# Altium schematic sheet phototransistors.SchDoc: Phototransostors (part 2 of 3) (continued)
## Parts (continued)
T345  B19H1PT--H9C000214U1930  [LED0603W]  (value not drawn)
T346  B19H1PT--H9C000214U1930  [LED0603W]  (value not drawn)
T347  B19H1PT--H9C000214U1930  [LED0603W]  (value not drawn)
T348  B19H1PT--H9C000214U1930  [LED0603W]  (value not drawn)
T349  B19H1PT--H9C000214U1930  [LED0603W]  (value not drawn)
T350  B19H1PT--H9C000214U1930  [LED0603W]  (value not drawn)
T351  B19H1PT--H9C000214U1930  [LED0603W]  (value not drawn)
T352  B19H1PT--H9C000214U1930  [LED0603W]  (value not drawn)
T353  B19H1PT--H9C000214U1930  [LED0603W]  (value not drawn)
T354  B19H1PT--H9C000214U1930  [LED0603W]  (value not drawn)
T355  B19H1PT--H9C000214U1930  [LED0603W]  (value not drawn)
T356  B19H1PT--H9C000214U1930  [LED0603W]  (value not drawn)
T357  B19H1PT--H9C000214U1930  [LED0603W]  (value not drawn)
T358  B19H1PT--H9C000214U1930  [LED0603W]  (value not drawn)
T359  B19H1PT--H9C000214U1930  [LED0603W]  (value not drawn)
T360  B19H1PT--H9C000214U1930  [LED0603W]  (value not drawn)
T361  B19H1PT--H9C000214U1930  [LED0603W]  (value not drawn)
T362  B19H1PT--H9C000214U1930  [LED0603W]  (value not drawn)
T363  B19H1PT--H9C000214U1930  [LED0603W]  (value not drawn)
T364  B19H1PT--H9C000214U1930  [LED0603W]  (value not drawn)
T365  B19H1PT--H9C000214U1930  [LED0603W]  (value not drawn)
T366  B19H1PT--H9C000214U1930  [LED0603W]  (value not drawn)
T367  B19H1PT--H9C000214U1930  [LED0603W]  (value not drawn)
T368  B19H1PT--H9C000214U1930  [LED0603W]  (value not drawn)
T369  B19H1PT--H9C000214U1930  [LED0603W]  (value not drawn)
T370  B19H1PT--H9C000214U1930  [LED0603W]  (value not drawn)
T371  B19H1PT--H9C000214U1930  [LED0603W]  (value not drawn)
T372  B19H1PT--H9C000214U1930  [LED0603W]  (value not drawn)
T373  B19H1PT--H9C000214U1930  [LED0603W]  (value not drawn)
T374  B19H1PT--H9C000214U1930  [LED0603W]  (value not drawn)
T375  B19H1PT--H9C000214U1930  [LED0603W]  (value not drawn)
T376  B19H1PT--H9C000214U1930  [LED0603W]  (value not drawn)
T377  B19H1PT--H9C000214U1930  [LED0603W]  (value not drawn)
T378  B19H1PT--H9C000214U1930  [LED0603W]  (value not drawn)
T379  B19H1PT--H9C000214U1930  [LED0603W]  (value not drawn)
T380  B19H1PT--H9C000214U1930  [LED0603W]  (value not drawn)
T381  B19H1PT--H9C000214U1930  [LED0603W]  (value not drawn)
T382  B19H1PT--H9C000214U1930  [LED0603W]  (value not drawn)
T383  B19H1PT--H9C000214U1930  [LED0603W]  (value not drawn)
T384  B19H1PT--H9C000214U1930  [LED0603W]  (value not drawn)
T385  B19H1PT--H9C000214U1930  [LED0603W]  (value not drawn)
T386  B19H1PT--H9C000214U1930  [LED0603W]  (value not drawn)
T387  B19H1PT--H9C000214U1930  [LED0603W]  (value not drawn)
T388  B19H1PT--H9C000214U1930  [LED0603W]  (value not drawn)
T389  B19H1PT--H9C000214U1930  [LED0603W]  (value not drawn)
T390  B19H1PT--H9C000214U1930  [LED0603W]  (value not drawn)
T391  B19H1PT--H9C000214U1930  [LED0603W]  (value not drawn)
T392  B19H1PT--H9C000214U1930  [LED0603W]  (value not drawn)
T393  B19H1PT--H9C000214U1930  [LED0603W]  (value not drawn)
T394  B19H1PT--H9C000214U1930  [LED0603W]  (value not drawn)
T395  B19H1PT--H9C000214U1930  [LED0603W]  (value not drawn)
T396  B19H1PT--H9C000214U1930  [LED0603W]  (value not drawn)
T397  B19H1PT--H9C000214U1930  [LED0603W]  (value not drawn)
T398  B19H1PT--H9C000214U1930  [LED0603W]  (value not drawn)
T399  B19H1PT--H9C000214U1930  [LED0603W]  (value not drawn)
T400  B19H1PT--H9C000214U1930  [LED0603W]  (value not drawn)
T401  B19H1PT--H9C000214U1930  [LED0603W]  (value not drawn)
T402  B19H1PT--H9C000214U1930  [LED0603W]  (value not drawn)
T403  B19H1PT--H9C000214U1930  [LED0603W]  (value not drawn)
T404  B19H1PT--H9C000214U1930  [LED0603W]  (value not drawn)
T405  B19H1PT--H9C000214U1930  [LED0603W]  (value not drawn)
T406  B19H1PT--H9C000214U1930  [LED0603W]  (value not drawn)
T407  B19H1PT--H9C000214U1930  [LED0603W]  (value not drawn)
T408  B19H1PT--H9C000214U1930  [LED0603W]  (value not drawn)
T409  B19H1PT--H9C000214U1930  [LED0603W]  (value not drawn)
T410  B19H1PT--H9C000214U1930  [LED0603W]  (value not drawn)
T411  B19H1PT--H9C000214U1930  [LED0603W]  (value not drawn)
T412  B19H1PT--H9C000214U1930  [LED0603W]  (value not drawn)
T413  B19H1PT--H9C000214U1930  [LED0603W]  (value not drawn)
T414  B19H1PT--H9C000214U1930  [LED0603W]  (value not drawn)
T415  B19H1PT--H9C000214U1930  [LED0603W]  (value not drawn)
T416  B19H1PT--H9C000214U1930  [LED0603W]  (value not drawn)
T417  B19H1PT--H9C000214U1930  [LED0603W]  (value not drawn)
T418  B19H1PT--H9C000214U1930  [LED0603W]  (value not drawn)
T419  B19H1PT--H9C000214U1930  [LED0603W]  (value not drawn)
T420  B19H1PT--H9C000214U1930  [LED0603W]  (value not drawn)
T421  B19H1PT--H9C000214U1930  [LED0603W]  (value not drawn)
T422  B19H1PT--H9C000214U1930  [LED0603W]  (value not drawn)
T423  B19H1PT--H9C000214U1930  [LED0603W]  (value not drawn)
T424  B19H1PT--H9C000214U1930  [LED0603W]  (value not drawn)
T425  B19H1PT--H9C000214U1930  [LED0603W]  (value not drawn)
T426  B19H1PT--H9C000214U1930  [LED0603W]  (value not drawn)
T427  B19H1PT--H9C000214U1930  [LED0603W]  (value not drawn)
T428  B19H1PT--H9C000214U1930  [LED0603W]  (value not drawn)
T429  B19H1PT--H9C000214U1930  [LED0603W]  (value not drawn)
T430  B19H1PT--H9C000214U1930  [LED0603W]  (value not drawn)
T431  B19H1PT--H9C000214U1930  [LED0603W]  (value not drawn)
T432  B19H1PT--H9C000214U1930  [LED0603W]  (value not drawn)
T433  B19H1PT--H9C000214U1930  [LED0603W]  (value not drawn)
T434  B19H1PT--H9C000214U1930  [LED0603W]  (value not drawn)
T435  B19H1PT--H9C000214U1930  [LED0603W]  (value not drawn)
T436  B19H1PT--H9C000214U1930  [LED0603W]  (value not drawn)
T437  B19H1PT--H9C000214U1930  [LED0603W]  (value not drawn)
T438  B19H1PT--H9C000214U1930  [LED0603W]  (value not drawn)
T439  B19H1PT--H9C000214U1930  [LED0603W]  (value not drawn)
T440  B19H1PT--H9C000214U1930  [LED0603W]  (value not drawn)
T441  B19H1PT--H9C000214U1930  [LED0603W]  (value not drawn)
T442  B19H1PT--H9C000214U1930  [LED0603W]  (value not drawn)
T443  B19H1PT--H9C000214U1930  [LED0603W]  (value not drawn)
T444  B19H1PT--H9C000214U1930  [LED0603W]  (value not drawn)
T445  B19H1PT--H9C000214U1930  [LED0603W]  (value not drawn)
T446  B19H1PT--H9C000214U1930  [LED0603W]  (value not drawn)
T447  B19H1PT--H9C000214U1930  [LED0603W]  (value not drawn)
T448  B19H1PT--H9C000214U1930  [LED0603W]  (value not drawn)
T449  B19H1PT--H9C000214U1930  [LED0603W]  (value not drawn)
T450  B19H1PT--H9C000214U1930  [LED0603W]  (value not drawn)
T451  B19H1PT--H9C000214U1930  [LED0603W]  (value not drawn)
T452  B19H1PT--H9C000214U1930  [LED0603W]  (value not drawn)
T453  B19H1PT--H9C000214U1930  [LED0603W]  (value not drawn)
T454  B19H1PT--H9C000214U1930  [LED0603W]  (value not drawn)
T455  B19H1PT--H9C000214U1930  [LED0603W]  (value not drawn)
T456  B19H1PT--H9C000214U1930  [LED0603W]  (value not drawn)
T457  B19H1PT--H9C000214U1930  [LED0603W]  (value not drawn)
T458  B19H1PT--H9C000214U1930  [LED0603W]  (value not drawn)
T459  B19H1PT--H9C000214U1930  [LED0603W]  (value not drawn)
T460  B19H1PT--H9C000214U1930  [LED0603W]  (value not drawn)
T461  B19H1PT--H9C000214U1930  [LED0603W]  (value not drawn)
T462  B19H1PT--H9C000214U1930  [LED0603W]  (value not drawn)
T463  B19H1PT--H9C000214U1930  [LED0603W]  (value not drawn)
T464  B19H1PT--H9C000214U1930  [LED0603W]  (value not drawn)
T465  B19H1PT--H9C000214U1930  [LED0603W]  (value not drawn)
T466  B19H1PT--H9C000214U1930  [LED0603W]  (value not drawn)
T467  B19H1PT--H9C000214U1930  [LED0603W]  (value not drawn)
T468  B19H1PT--H9C000214U1930  [LED0603W]  (value not drawn)
T469  B19H1PT--H9C000214U1930  [LED0603W]  (value not drawn)
T470  B19H1PT--H9C000214U1930  [LED0603W]  (value not drawn)
T471  B19H1PT--H9C000214U1930  [LED0603W]  (value not drawn)
T472  B19H1PT--H9C000214U1930  [LED0603W]  (value not drawn)
T473  B19H1PT--H9C000214U1930  [LED0603W]  (value not drawn)
T474  B19H1PT--H9C000214U1930  [LED0603W]  (value not drawn)
T475  B19H1PT--H9C000214U1930  [LED0603W]  (value not drawn)
T476  B19H1PT--H9C000214U1930  [LED0603W]  (value not drawn)
T477  B19H1PT--H9C000214U1930  [LED0603W]  (value not drawn)
T478  B19H1PT--H9C000214U1930  [LED0603W]  (value not drawn)
T479  B19H1PT--H9C000214U1930  [LED0603W]  (value not drawn)
T480  B19H1PT--H9C000214U1930  [LED0603W]  (value not drawn)
T481  B19H1PT--H9C000214U1930  [LED0603W]  (value not drawn)
T482  B19H1PT--H9C000214U1930  [LED0603W]  (value not drawn)
T483  B19H1PT--H9C000214U1930  [LED0603W]  (value not drawn)
T484  B19H1PT--H9C000214U1930  [LED0603W]  (value not drawn)
T485  B19H1PT--H9C000214U1930  [LED0603W]  (value not drawn)
T486  B19H1PT--H9C000214U1930  [LED0603W]  (value not drawn)
T487  B19H1PT--H9C000214U1930  [LED0603W]  (value not drawn)
T488  B19H1PT--H9C000214U1930  [LED0603W]  (value not drawn)
T489  B19H1PT--H9C000214U1930  [LED0603W]  (value not drawn)
T490  B19H1PT--H9C000214U1930  [LED0603W]  (value not drawn)
T491  B19H1PT--H9C000214U1930  [LED0603W]  (value not drawn)
T492  B19H1PT--H9C000214U1930  [LED0603W]  (value not drawn)
T493  B19H1PT--H9C000214U1930  [LED0603W]  (value not drawn)
T494  B19H1PT--H9C000214U1930  [LED0603W]  (value not drawn)
T495  B19H1PT--H9C000214U1930  [LED0603W]  (value not drawn)
T496  B19H1PT--H9C000214U1930  [LED0603W]  (value not drawn)
T497  B19H1PT--H9C000214U1930  [LED0603W]  (value not drawn)
T498  B19H1PT--H9C000214U1930  [LED0603W]  (value not drawn)
T499  B19H1PT--H9C000214U1930  [LED0603W]  (value not drawn)
T500  B19H1PT--H9C000214U1930  [LED0603W]  (value not drawn)
T501  B19H1PT--H9C000214U1930  [LED0603W]  (value not drawn)
T502  B19H1PT--H9C000214U1930  [LED0603W]  (value not drawn)
T503  B19H1PT--H9C000214U1930  [LED0603W]  (value not drawn)
T504  B19H1PT--H9C000214U1930  [LED0603W]  (value not drawn)
T505  B19H1PT--H9C000214U1930  [LED0603W]  (value not drawn)
T506  B19H1PT--H9C000214U1930  [LED0603W]  (value not drawn)
T507  B19H1PT--H9C000214U1930  [LED0603W]  (value not drawn)
T508  B19H1PT--H9C000214U1930  [LED0603W]  (value not drawn)
T509  B19H1PT--H9C000214U1930  [LED0603W]  (value not drawn)
T510  B19H1PT--H9C000214U1930  [LED0603W]  (value not drawn)
T511  B19H1PT--H9C000214U1930  [LED0603W]  (value not drawn)
T512  B19H1PT--H9C000214U1930  [LED0603W]  (value not drawn)
T513  B19H1PT--H9C000214U1930  [LED0603W]  (value not drawn)
T514  B19H1PT--H9C000214U1930  [LED0603W]  (value not drawn)
T515  B19H1PT--H9C000214U1930  [LED0603W]  (value not drawn)
T516  B19H1PT--H9C000214U1930  [LED0603W]  (value not drawn)
T517  B19H1PT--H9C000214U1930  [LED0603W]  (value not drawn)
T518  B19H1PT--H9C000214U1930  [LED0603W]  (value not drawn)
T519  B19H1PT--H9C000214U1930  [LED0603W]  (value not drawn)
T520  B19H1PT--H9C000214U1930  [LED0603W]  (value not drawn)
T521  B19H1PT--H9C000214U1930  [LED0603W]  (value not drawn)
T522  B19H1PT--H9C000214U1930  [LED0603W]  (value not drawn)
T523  B19H1PT--H9C000214U1930  [LED0603W]  (value not drawn)
T524  B19H1PT--H9C000214U1930  [LED0603W]  (value not drawn)
T525  B19H1PT--H9C000214U1930  [LED0603W]  (value not drawn)
T526  B19H1PT--H9C000214U1930  [LED0603W]  (value not drawn)
T527  B19H1PT--H9C000214U1930  [LED0603W]  (value not drawn)
T528  B19H1PT--H9C000214U1930  [LED0603W]  (value not drawn)
T529  B19H1PT--H9C000214U1930  [LED0603W]  (value not drawn)
T530  B19H1PT--H9C000214U1930  [LED0603W]  (value not drawn)
T531  B19H1PT--H9C000214U1930  [LED0603W]  (value not drawn)
T532  B19H1PT--H9C000214U1930  [LED0603W]  (value not drawn)
T533  B19H1PT--H9C000214U1930  [LED0603W]  (value not drawn)
T534  B19H1PT--H9C000214U1930  [LED0603W]  (value not drawn)
T535  B19H1PT--H9C000214U1930  [LED0603W]  (value not drawn)
T536  B19H1PT--H9C000214U1930  [LED0603W]  (value not drawn)
T537  B19H1PT--H9C000214U1930  [LED0603W]  (value not drawn)
T538  B19H1PT--H9C000214U1930  [LED0603W]  (value not drawn)
T539  B19H1PT--H9C000214U1930  [LED0603W]  (value not drawn)
T540  B19H1PT--H9C000214U1930  [LED0603W]  (value not drawn)
T541  B19H1PT--H9C000214U1930  [LED0603W]  (value not drawn)
T542  B19H1PT--H9C000214U1930  [LED0603W]  (value not drawn)
T543  B19H1PT--H9C000214U1930  [LED0603W]  (value not drawn)
T544  B19H1PT--H9C000214U1930  [LED0603W]  (value not drawn)
T545  B19H1PT--H9C000214U1930  [LED0603W]  (value not drawn)
T546  B19H1PT--H9C000214U1930  [LED0603W]  (value not drawn)
T547  B19H1PT--H9C000214U1930  [LED0603W]  (value not drawn)
T548  B19H1PT--H9C000214U1930  [LED0603W]  (value not drawn)
T549  B19H1PT--H9C000214U1930  [LED0603W]  (value not drawn)
T550  B19H1PT--H9C000214U1930  [LED0603W]  (value not drawn)
T551  B19H1PT--H9C000214U1930  [LED0603W]  (value not drawn)
T552  B19H1PT--H9C000214U1930  [LED0603W]  (value not drawn)
T553  B19H1PT--H9C000214U1930  [LED0603W]  (value not drawn)
T554  B19H1PT--H9C000214U1930  [LED0603W]  (value not drawn)
T555  B19H1PT--H9C000214U1930  [LED0603W]  (value not drawn)
T556  B19H1PT--H9C000214U1930  [LED0603W]  (value not drawn)
T557  B19H1PT--H9C000214U1930  [LED0603W]  (value not drawn)
T558  B19H1PT--H9C000214U1930  [LED0603W]  (value not drawn)
T559  B19H1PT--H9C000214U1930  [LED0603W]  (value not drawn)
T560  B19H1PT--H9C000214U1930  [LED0603W]  (value not drawn)
T561  B19H1PT--H9C000214U1930  [LED0603W]  (value not drawn)
T562  B19H1PT--H9C000214U1930  [LED0603W]  (value not drawn)
T563  B19H1PT--H9C000214U1930  [LED0603W]  (value not drawn)
T564  B19H1PT--H9C000214U1930  [LED0603W]  (value not drawn)
T565  B19H1PT--H9C000214U1930  [LED0603W]  (value not drawn)
T566  B19H1PT--H9C000214U1930  [LED0603W]  (value not drawn)
T567  B19H1PT--H9C000214U1930  [LED0603W]  (value not drawn)
T568  B19H1PT--H9C000214U1930  [LED0603W]  (value not drawn)
T569  B19H1PT--H9C000214U1930  [LED0603W]  (value not drawn)
T570  B19H1PT--H9C000214U1930  [LED0603W]  (value not drawn)
T571  B19H1PT--H9C000214U1930  [LED0603W]  (value not drawn)
T572  B19H1PT--H9C000214U1930  [LED0603W]  (value not drawn)
T573  B19H1PT--H9C000214U1930  [LED0603W]  (value not drawn)
T574  B19H1PT--H9C000214U1930  [LED0603W]  (value not drawn)
T575  B19H1PT--H9C000214U1930  [LED0603W]  (value not drawn)
T576  B19H1PT--H9C000214U1930  [LED0603W]  (value not drawn)
T577  B19H1PT--H9C000214U1930  [LED0603W]  (value not drawn)
T578  B19H1PT--H9C000214U1930  [LED0603W]  (value not drawn)
T579  B19H1PT--H9C000214U1930  [LED0603W]  (value not drawn)
T580  B19H1PT--H9C000214U1930  [LED0603W]  (value not drawn)
T581  B19H1PT--H9C000214U1930  [LED0603W]  (value not drawn)
T582  B19H1PT--H9C000214U1930  [LED0603W]  (value not drawn)
T583  B19H1PT--H9C000214U1930  [LED0603W]  (value not drawn)
T584  B19H1PT--H9C000214U1930  [LED0603W]  (value not drawn)
T585  B19H1PT--H9C000214U1930  [LED0603W]  (value not drawn)
T586  B19H1PT--H9C000214U1930  [LED0603W]  (value not drawn)
T587  B19H1PT--H9C000214U1930  [LED0603W]  (value not drawn)
T588  B19H1PT--H9C000214U1930  [LED0603W]  (value not drawn)
T589  B19H1PT--H9C000214U1930  [LED0603W]  (value not drawn)
T590  B19H1PT--H9C000214U1930  [LED0603W]  (value not drawn)
T591  B19H1PT--H9C000214U1930  [LED0603W]  (value not drawn)
T592  B19H1PT--H9C000214U1930  [LED0603W]  (value not drawn)
T593  B19H1PT--H9C000214U1930  [LED0603W]  (value not drawn)
T594  B19H1PT--H9C000214U1930  [LED0603W]  (value not drawn)
T595  B19H1PT--H9C000214U1930  [LED0603W]  (value not drawn)
T596  B19H1PT--H9C000214U1930  [LED0603W]  (value not drawn)
T597  B19H1PT--H9C000214U1930  [LED0603W]  (value not drawn)
T598  B19H1PT--H9C000214U1930  [LED0603W]  (value not drawn)
T599  B19H1PT--H9C000214U1930  [LED0603W]  (value not drawn)
T600  B19H1PT--H9C000214U1930  [LED0603W]  (value not drawn)
T601  B19H1PT--H9C000214U1930  [LED0603W]  (value not drawn)
T602  B19H1PT--H9C000214U1930  [LED0603W]  (value not drawn)
T603  B19H1PT--H9C000214U1930  [LED0603W]  (value not drawn)
T604  B19H1PT--H9C000214U1930  [LED0603W]  (value not drawn)
T605  B19H1PT--H9C000214U1930  [LED0603W]  (value not drawn)
T606  B19H1PT--H9C000214U1930  [LED0603W]  (value not drawn)
T607  B19H1PT--H9C000214U1930  [LED0603W]  (value not drawn)
T608  B19H1PT--H9C000214U1930  [LED0603W]  (value not drawn)
T609  B19H1PT--H9C000214U1930  [LED0603W]  (value not drawn)
T610  B19H1PT--H9C000214U1930  [LED0603W]  (value not drawn)
T611  B19H1PT--H9C000214U1930  [LED0603W]  (value not drawn)
T612  B19H1PT--H9C000214U1930  [LED0603W]  (value not drawn)
T613  B19H1PT--H9C000214U1930  [LED0603W]  (value not drawn)
T614  B19H1PT--H9C000214U1930  [LED0603W]  (value not drawn)
T615  B19H1PT--H9C000214U1930  [LED0603W]  (value not drawn)
T616  B19H1PT--H9C000214U1930  [LED0603W]  (value not drawn)
T617  B19H1PT--H9C000214U1930  [LED0603W]  (value not drawn)
T618  B19H1PT--H9C000214U1930  [LED0603W]  (value not drawn)
T619  B19H1PT--H9C000214U1930  [LED0603W]  (value not drawn)
T620  B19H1PT--H9C000214U1930  [LED0603W]  (value not drawn)
T621  B19H1PT--H9C000214U1930  [LED0603W]  (value not drawn)
T622  B19H1PT--H9C000214U1930  [LED0603W]  (value not drawn)
T623  B19H1PT--H9C000214U1930  [LED0603W]  (value not drawn)
T624  B19H1PT--H9C000214U1930  [LED0603W]  (value not drawn)
T625  B19H1PT--H9C000214U1930  [LED0603W]  (value not drawn)
T626  B19H1PT--H9C000214U1930  [LED0603W]  (value not drawn)
T627  B19H1PT--H9C000214U1930  [LED0603W]  (value not drawn)
T628  B19H1PT--H9C000214U1930  [LED0603W]  (value not drawn)
T629  B19H1PT--H9C000214U1930  [LED0603W]  (value not drawn)
T630  B19H1PT--H9C000214U1930  [LED0603W]  (value not drawn)
T631  B19H1PT--H9C000214U1930  [LED0603W]  (value not drawn)
T632  B19H1PT--H9C000214U1930  [LED0603W]  (value not drawn)
T633  B19H1PT--H9C000214U1930  [LED0603W]  (value not drawn)
T634  B19H1PT--H9C000214U1930  [LED0603W]  (value not drawn)
T635  B19H1PT--H9C000214U1930  [LED0603W]  (value not drawn)
T636  B19H1PT--H9C000214U1930  [LED0603W]  (value not drawn)
T637  B19H1PT--H9C000214U1930  [LED0603W]  (value not drawn)
T638  B19H1PT--H9C000214U1930  [LED0603W]  (value not drawn)
T639  B19H1PT--H9C000214U1930  [LED0603W]  (value not drawn)
T640  B19H1PT--H9C000214U1930  [LED0603W]  (value not drawn)
T641  B19H1PT--H9C000214U1930  [LED0603W]  (value not drawn)
T642  B19H1PT--H9C000214U1930  [LED0603W]  (value not drawn)
T643  B19H1PT--H9C000214U1930  [LED0603W]  (value not drawn)
T644  B19H1PT--H9C000214U1930  [LED0603W]  (value not drawn)
T645  B19H1PT--H9C000214U1930  [LED0603W]  (value not drawn)
T646  B19H1PT--H9C000214U1930  [LED0603W]  (value not drawn)
T647  B19H1PT--H9C000214U1930  [LED0603W]  (value not drawn)
T648  B19H1PT--H9C000214U1930  [LED0603W]  (value not drawn)
T649  B19H1PT--H9C000214U1930  [LED0603W]  (value not drawn)
T650  B19H1PT--H9C000214U1930  [LED0603W]  (value not drawn)
T651  B19H1PT--H9C000214U1930  [LED0603W]  (value not drawn)
T652  B19H1PT--H9C000214U1930  [LED0603W]  (value not drawn)
T653  B19H1PT--H9C000214U1930  [LED0603W]  (value not drawn)
T654  B19H1PT--H9C000214U1930  [LED0603W]  (value not drawn)
T655  B19H1PT--H9C000214U1930  [LED0603W]  (value not drawn)
T656  B19H1PT--H9C000214U1930  [LED0603W]  (value not drawn)
T657  B19H1PT--H9C000214U1930  [LED0603W]  (value not drawn)
T658  B19H1PT--H9C000214U1930  [LED0603W]  (value not drawn)
T659  B19H1PT--H9C000214U1930  [LED0603W]  (value not drawn)
T660  B19H1PT--H9C000214U1930  [LED0603W]  (value not drawn)
T661  B19H1PT--H9C000214U1930  [LED0603W]  (value not drawn)
T662  B19H1PT--H9C000214U1930  [LED0603W]  (value not drawn)
T663  B19H1PT--H9C000214U1930  [LED0603W]  (value not drawn)
T664  B19H1PT--H9C000214U1930  [LED0603W]  (value not drawn)
T665  B19H1PT--H9C000214U1930  [LED0603W]  (value not drawn)
T666  B19H1PT--H9C000214U1930  [LED0603W]  (value not drawn)
T667  B19H1PT--H9C000214U1930  [LED0603W]  (value not drawn)
T668  B19H1PT--H9C000214U1930  [LED0603W]  (value not drawn)
T669  B19H1PT--H9C000214U1930  [LED0603W]  (value not drawn)
T670  B19H1PT--H9C000214U1930  [LED0603W]  (value not drawn)
T671  B19H1PT--H9C000214U1930  [LED0603W]  (value not drawn)
T672  B19H1PT--H9C000214U1930  [LED0603W]  (value not drawn)
T673  B19H1PT--H9C000214U1930  [LED0603W]  (value not drawn)
T674  B19H1PT--H9C000214U1930  [LED0603W]  (value not drawn)
T675  B19H1PT--H9C000214U1930  [LED0603W]  (value not drawn)
T676  B19H1PT--H9C000214U1930  [LED0603W]  (value not drawn)
T677  B19H1PT--H9C000214U1930  [LED0603W]  (value not drawn)
T678  B19H1PT--H9C000214U1930  [LED0603W]  (value not drawn)
T679  B19H1PT--H9C000214U1930  [LED0603W]  (value not drawn)
T680  B19H1PT--H9C000214U1930  [LED0603W]  (value not drawn)
T681  B19H1PT--H9C000214U1930  [LED0603W]  (value not drawn)
T682  B19H1PT--H9C000214U1930  [LED0603W]  (value not drawn)
T683  B19H1PT--H9C000214U1930  [LED0603W]  (value not drawn)
T684  B19H1PT--H9C000214U1930  [LED0603W]  (value not drawn)
T685  B19H1PT--H9C000214U1930  [LED0603W]  (value not drawn)
T686  B19H1PT--H9C000214U1930  [LED0603W]  (value not drawn)
T687  B19H1PT--H9C000214U1930  [LED0603W]  (value not drawn)
T688  B19H1PT--H9C000214U1930  [LED0603W]  (value not drawn)
T689  B19H1PT--H9C000214U1930  [LED0603W]  (value not drawn)
T690  B19H1PT--H9C000214U1930  [LED0603W]  (value not drawn)
T691  B19H1PT--H9C000214U1930  [LED0603W]  (value not drawn)
T692  B19H1PT--H9C000214U1930  [LED0603W]  (value not drawn)
T693  B19H1PT--H9C000214U1930  [LED0603W]  (value not drawn)
T694  B19H1PT--H9C000214U1930  [LED0603W]  (value not drawn)
T695  B19H1PT--H9C000214U1930  [LED0603W]  (value not drawn)
T696  B19H1PT--H9C000214U1930  [LED0603W]  (value not drawn)
T697  B19H1PT--H9C000214U1930  [LED0603W]  (value not drawn)
T698  B19H1PT--H9C000214U1930  [LED0603W]  (value not drawn)
T699  B19H1PT--H9C000214U1930  [LED0603W]  (value not drawn)
T700  B19H1PT--H9C000214U1930  [LED0603W]  (value not drawn)
T701  B19H1PT--H9C000214U1930  [LED0603W]  (value not drawn)
T702  B19H1PT--H9C000214U1930  [LED0603W]  (value not drawn)
T703  B19H1PT--H9C000214U1930  [LED0603W]  (value not drawn)
T704  B19H1PT--H9C000214U1930  [LED0603W]  (value not drawn)
T705  B19H1PT--H9C000214U1930  [LED0603W]  (value not drawn)
T706  B19H1PT--H9C000214U1930  [LED0603W]  (value not drawn)
T707  B19H1PT--H9C000214U1930  [LED0603W]  (value not drawn)
T708  B19H1PT--H9C000214U1930  [LED0603W]  (value not drawn)
T709  B19H1PT--H9C000214U1930  [LED0603W]  (value not drawn)
T710  B19H1PT--H9C000214U1930  [LED0603W]  (value not drawn)
T711  B19H1PT--H9C000214U1930  [LED0603W]  (value not drawn)
T712  B19H1PT--H9C000214U1930  [LED0603W]  (value not drawn)
T713  B19H1PT--H9C000214U1930  [LED0603W]  (value not drawn)
T714  B19H1PT--H9C000214U1930  [LED0603W]  (value not drawn)
T715  B19H1PT--H9C000214U1930  [LED0603W]  (value not drawn)
T716  B19H1PT--H9C000214U1930  [LED0603W]  (value not drawn)
T717  B19H1PT--H9C000214U1930  [LED0603W]  (value not drawn)
T718  B19H1PT--H9C000214U1930  [LED0603W]  (value not drawn)
T719  B19H1PT--H9C000214U1930  [LED0603W]  (value not drawn)
T720  B19H1PT--H9C000214U1930  [LED0603W]  (value not drawn)
T721  B19H1PT--H9C000214U1930  [LED0603W]  (value not drawn)
T722  B19H1PT--H9C000214U1930  [LED0603W]  (value not drawn)
T723  B19H1PT--H9C000214U1930  [LED0603W]  (value not drawn)
T724  B19H1PT--H9C000214U1930  [LED0603W]  (value not drawn)
T725  B19H1PT--H9C000214U1930  [LED0603W]  (value not drawn)
T726  B19H1PT--H9C000214U1930  [LED0603W]  (value not drawn)
T727  B19H1PT--H9C000214U1930  [LED0603W]  (value not drawn)
T728  B19H1PT--H9C000214U1930  [LED0603W]  (value not drawn)
T729  B19H1PT--H9C000214U1930  [LED0603W]  (value not drawn)
T730  B19H1PT--H9C000214U1930  [LED0603W]  (value not drawn)
T731  B19H1PT--H9C000214U1930  [LED0603W]  (value not drawn)
T732  B19H1PT--H9C000214U1930  [LED0603W]  (value not drawn)
T733  B19H1PT--H9C000214U1930  [LED0603W]  (value not drawn)
T734  B19H1PT--H9C000214U1930  [LED0603W]  (value not drawn)
T735  B19H1PT--H9C000214U1930  [LED0603W]  (value not drawn)
T736  B19H1PT--H9C000214U1930  [LED0603W]  (value not drawn)
T737  B19H1PT--H9C000214U1930  [LED0603W]  (value not drawn)
T738  B19H1PT--H9C000214U1930  [LED0603W]  (value not drawn)
T739  B19H1PT--H9C000214U1930  [LED0603W]  (value not drawn)
T740  B19H1PT--H9C000214U1930  [LED0603W]  (value not drawn)
T741  B19H1PT--H9C000214U1930  [LED0603W]  (value not drawn)
T742  B19H1PT--H9C000214U1930  [LED0603W]  (value not drawn)
T743  B19H1PT--H9C000214U1930  [LED0603W]  (value not drawn)
T744  B19H1PT--H9C000214U1930  [LED0603W]  (value not drawn)
T745  B19H1PT--H9C000214U1930  [LED0603W]  (value not drawn)
T746  B19H1PT--H9C000214U1930  [LED0603W]  (value not drawn)
T747  B19H1PT--H9C000214U1930  [LED0603W]  (value not drawn)
T748  B19H1PT--H9C000214U1930  [LED0603W]  (value not drawn)
T749  B19H1PT--H9C000214U1930  [LED0603W]  (value not drawn)
T750  B19H1PT--H9C000214U1930  [LED0603W]  (value not drawn)
T751  B19H1PT--H9C000214U1930  [LED0603W]  (value not drawn)
T752  B19H1PT--H9C000214U1930  [LED0603W]  (value not drawn)
T753  B19H1PT--H9C000214U1930  [LED0603W]  (value not drawn)
T754  B19H1PT--H9C000214U1930  [LED0603W]  (value not drawn)
T755  B19H1PT--H9C000214U1930  [LED0603W]  (value not drawn)
T756  B19H1PT--H9C000214U1930  [LED0603W]  (value not drawn)
T757  B19H1PT--H9C000214U1930  [LED0603W]  (value not drawn)
T758  B19H1PT--H9C000214U1930  [LED0603W]  (value not drawn)
T759  B19H1PT--H9C000214U1930  [LED0603W]  (value not drawn)
T760  B19H1PT--H9C000214U1930  [LED0603W]  (value not drawn)
T761  B19H1PT--H9C000214U1930  [LED0603W]  (value not drawn)
T762  B19H1PT--H9C000214U1930  [LED0603W]  (value not drawn)
T763  B19H1PT--H9C000214U1930  [LED0603W]  (value not drawn)
T764  B19H1PT--H9C000214U1930  [LED0603W]  (value not drawn)
T765  B19H1PT--H9C000214U1930  [LED0603W]  (value not drawn)
T766  B19H1PT--H9C000214U1930  [LED0603W]  (value not drawn)
T767  B19H1PT--H9C000214U1930  [LED0603W]  (value not drawn)
T768  B19H1PT--H9C000214U1930  [LED0603W]  (value not drawn)
T769  B19H1PT--H9C000214U1930  [LED0603W]  (value not drawn)
T770  B19H1PT--H9C000214U1930  [LED0603W]  (value not drawn)
T771  B19H1PT--H9C000214U1930  [LED0603W]  (value not drawn)
T772  B19H1PT--H9C000214U1930  [LED0603W]  (value not drawn)
T773  B19H1PT--H9C000214U1930  [LED0603W]  (value not drawn)
T774  B19H1PT--H9C000214U1930  [LED0603W]  (value not drawn)
T775  B19H1PT--H9C000214U1930  [LED0603W]  (value not drawn)
T776  B19H1PT--H9C000214U1930  [LED0603W]  (value not drawn)
T777  B19H1PT--H9C000214U1930  [LED0603W]  (value not drawn)
T778  B19H1PT--H9C000214U1930  [LED0603W]  (value not drawn)
T779  B19H1PT--H9C000214U1930  [LED0603W]  (value not drawn)
T780  B19H1PT--H9C000214U1930  [LED0603W]  (value not drawn)
T781  B19H1PT--H9C000214U1930  [LED0603W]  (value not drawn)
T782  B19H1PT--H9C000214U1930  [LED0603W]  (value not drawn)
T783  B19H1PT--H9C000214U1930  [LED0603W]  (value not drawn)
T784  B19H1PT--H9C000214U1930  [LED0603W]  (value not drawn)
T785  B19H1PT--H9C000214U1930  [LED0603W]  (value not drawn)
T786  B19H1PT--H9C000214U1930  [LED0603W]  (value not drawn)
T787  B19H1PT--H9C000214U1930  [LED0603W]  (value not drawn)
T788  B19H1PT--H9C000214U1930  [LED0603W]  (value not drawn)
T789  B19H1PT--H9C000214U1930  [LED0603W]  (value not drawn)
T790  B19H1PT--H9C000214U1930  [LED0603W]  (value not drawn)
T791  B19H1PT--H9C000214U1930  [LED0603W]  (value not drawn)
T792  B19H1PT--H9C000214U1930  [LED0603W]  (value not drawn)
T793  B19H1PT--H9C000214U1930  [LED0603W]  (value not drawn)
T794  B19H1PT--H9C000214U1930  [LED0603W]  (value not drawn)
T795  B19H1PT--H9C000214U1930  [LED0603W]  (value not drawn)
T796  B19H1PT--H9C000214U1930  [LED0603W]  (value not drawn)
T797  B19H1PT--H9C000214U1930  [LED0603W]  (value not drawn)
T798  B19H1PT--H9C000214U1930  [LED0603W]  (value not drawn)
T799  B19H1PT--H9C000214U1930  [LED0603W]  (value not drawn)
T800  B19H1PT--H9C000214U1930  [LED0603W]  (value not drawn)
T801  B19H1PT--H9C000214U1930  [LED0603W]  (value not drawn)
T802  B19H1PT--H9C000214U1930  [LED0603W]  (value not drawn)
T803  B19H1PT--H9C000214U1930  [LED0603W]  (value not drawn)
T804  B19H1PT--H9C000214U1930  [LED0603W]  (value not drawn)
T805  B19H1PT--H9C000214U1930  [LED0603W]  (value not drawn)
T806  B19H1PT--H9C000214U1930  [LED0603W]  (value not drawn)
T807  B19H1PT--H9C000214U1930  [LED0603W]  (value not drawn)
T808  B19H1PT--H9C000214U1930  [LED0603W]  (value not drawn)
T809  B19H1PT--H9C000214U1930  [LED0603W]  (value not drawn)
T810  B19H1PT--H9C000214U1930  [LED0603W]  (value not drawn)
T811  B19H1PT--H9C000214U1930  [LED0603W]  (value not drawn)
T812  B19H1PT--H9C000214U1930  [LED0603W]  (value not drawn)
T813  B19H1PT--H9C000214U1930  [LED0603W]  (value not drawn)
T814  B19H1PT--H9C000214U1930  [LED0603W]  (value not drawn)
T815  B19H1PT--H9C000214U1930  [LED0603W]  (value not drawn)
T816  B19H1PT--H9C000214U1930  [LED0603W]  (value not drawn)
T817  B19H1PT--H9C000214U1930  [LED0603W]  (value not drawn)
T818  B19H1PT--H9C000214U1930  [LED0603W]  (value not drawn)
T819  B19H1PT--H9C000214U1930  [LED0603W]  (value not drawn)
T820  B19H1PT--H9C000214U1930  [LED0603W]  (value not drawn)
T821  B19H1PT--H9C000214U1930  [LED0603W]  (value not drawn)